# Altium schematic sheet Schematic_Project.SchDoc
size 1143 x 1143 mm; SheetNumber: 1; SheetTotal: 1
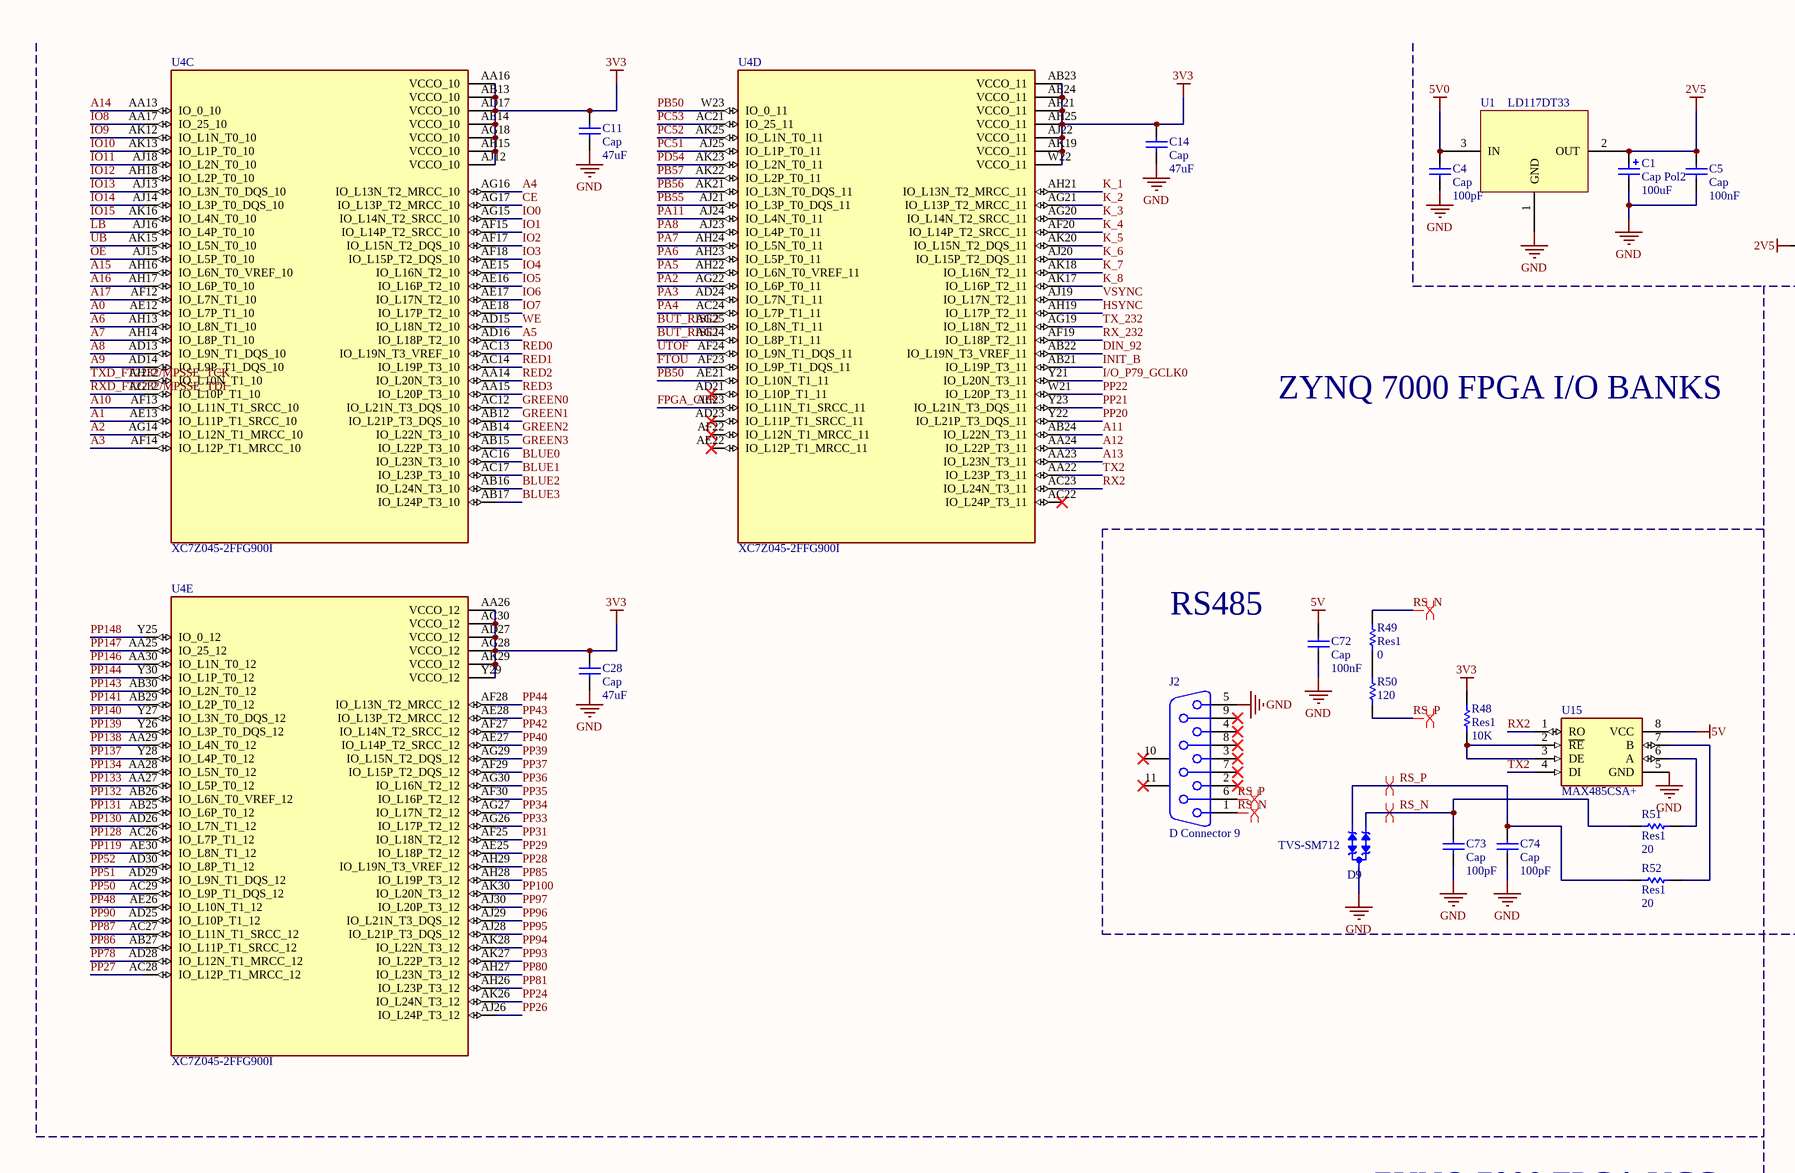
[diagram p0: Schematic_Project.SchDoc, top left]
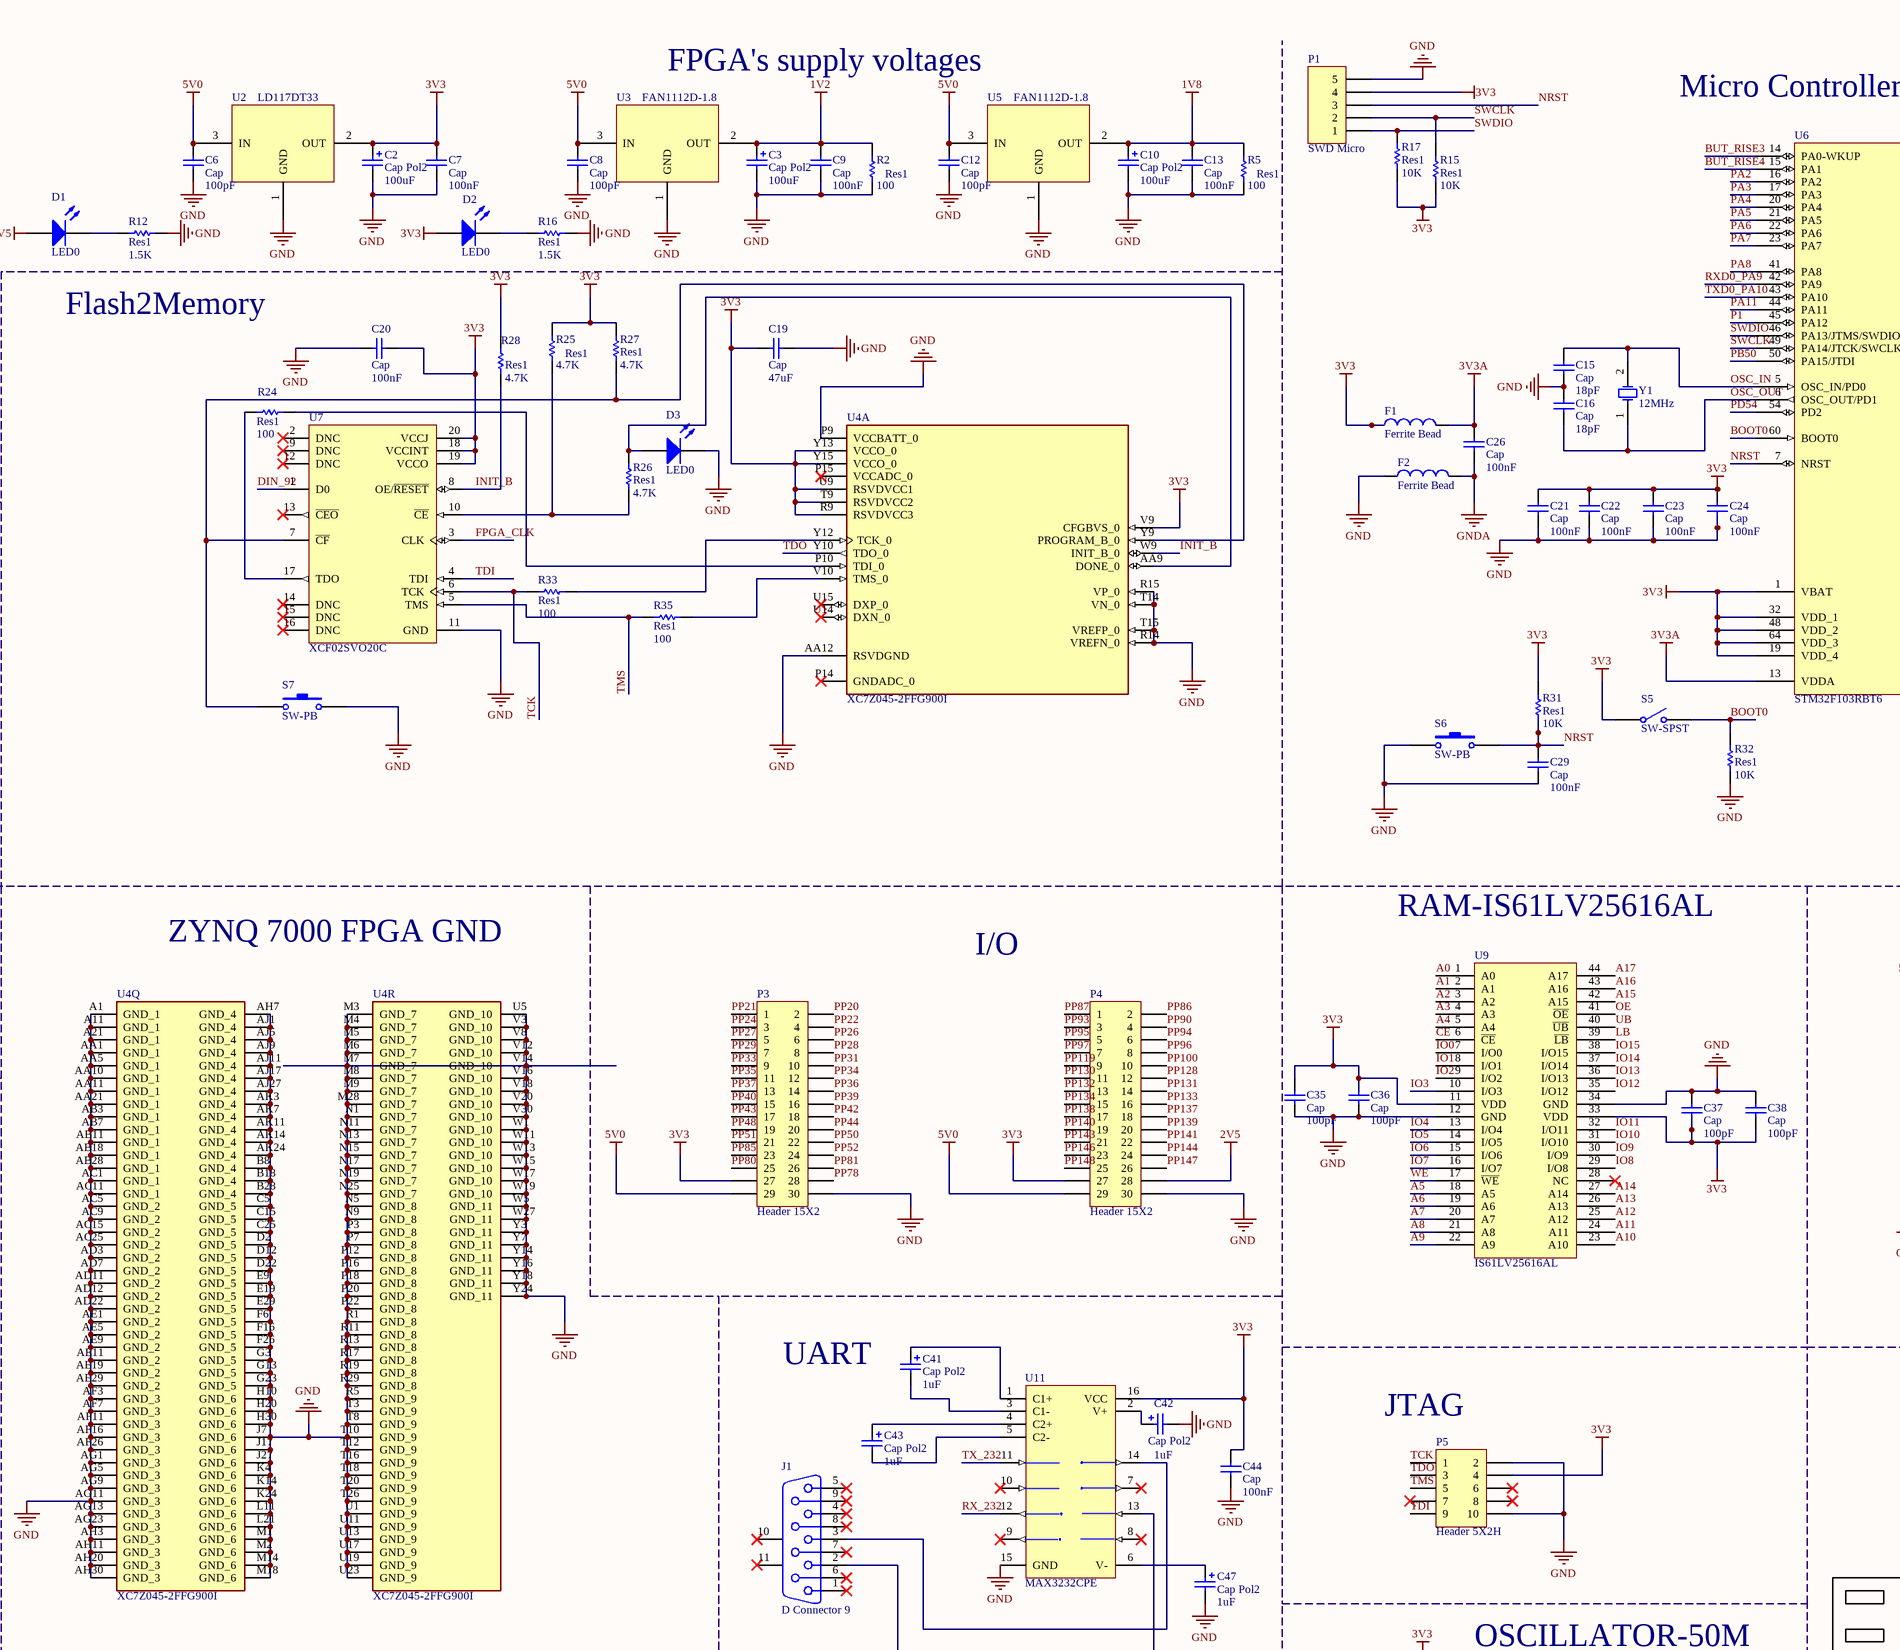
[diagram p1: Schematic_Project.SchDoc, top middle]
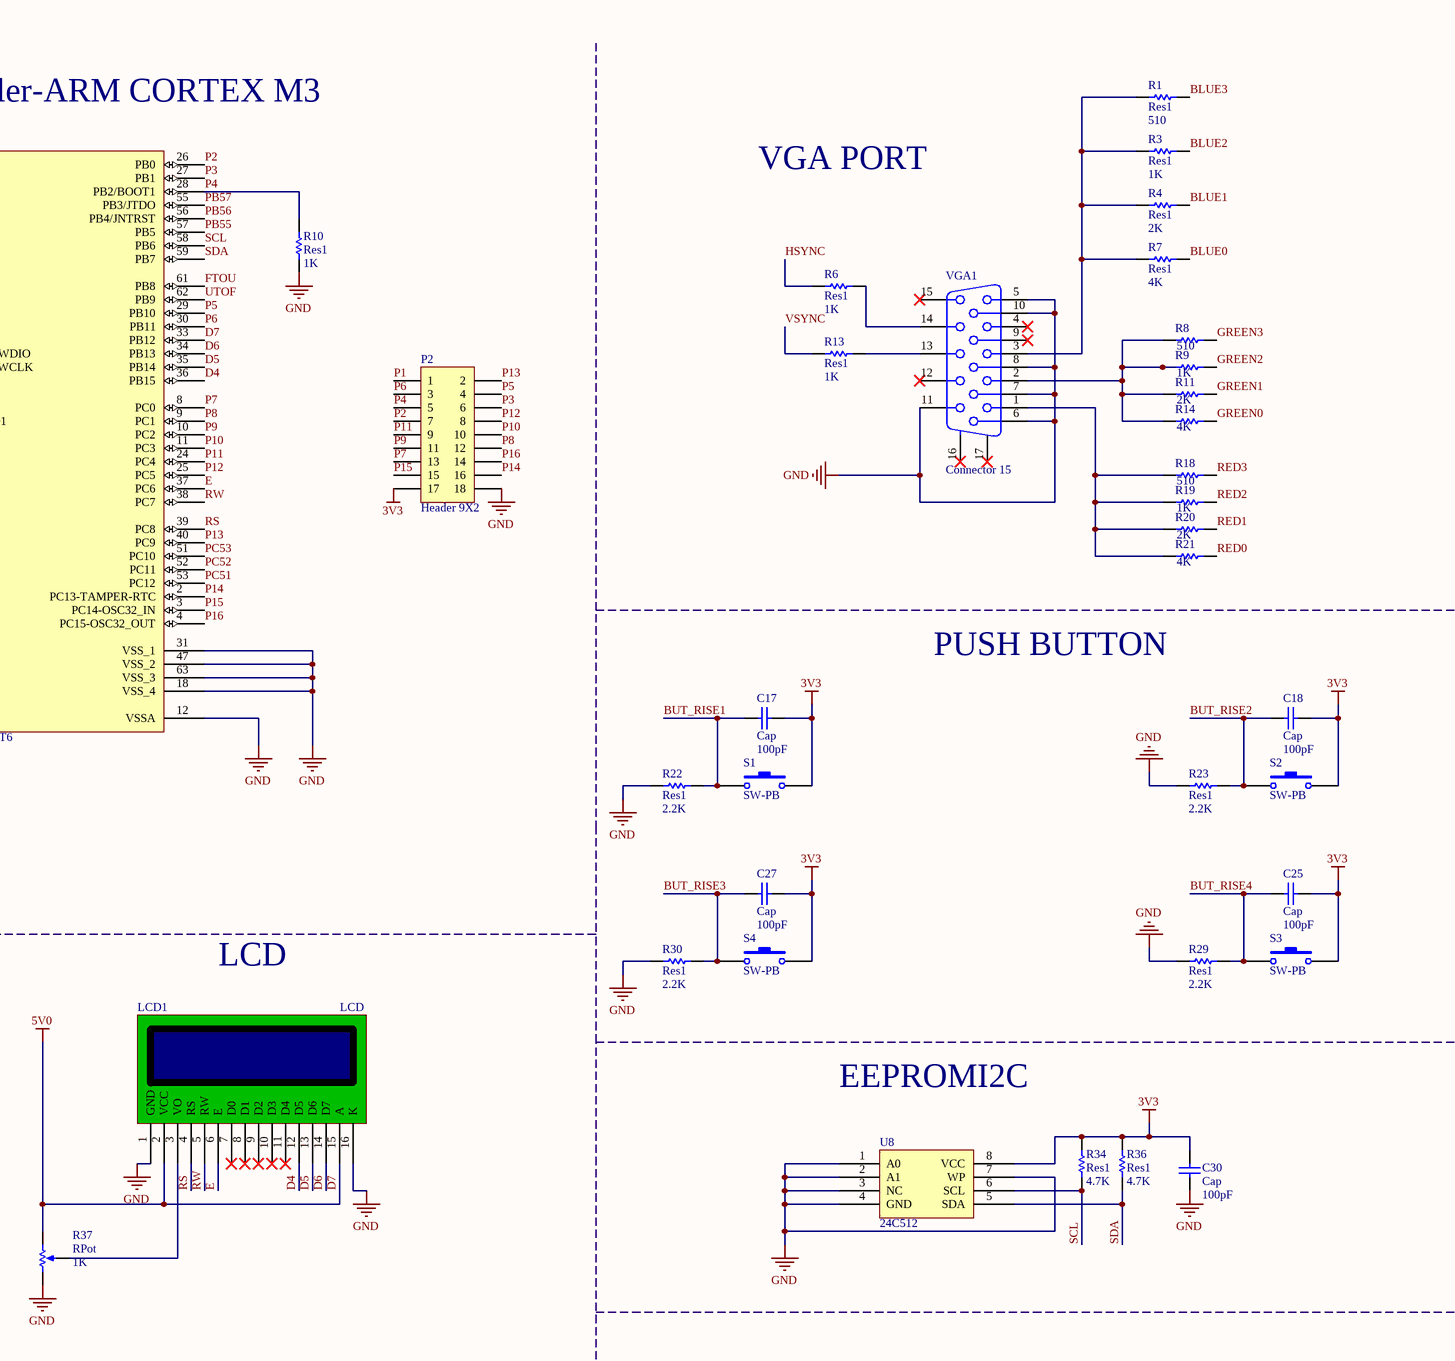
[diagram p2: Schematic_Project.SchDoc, top right]
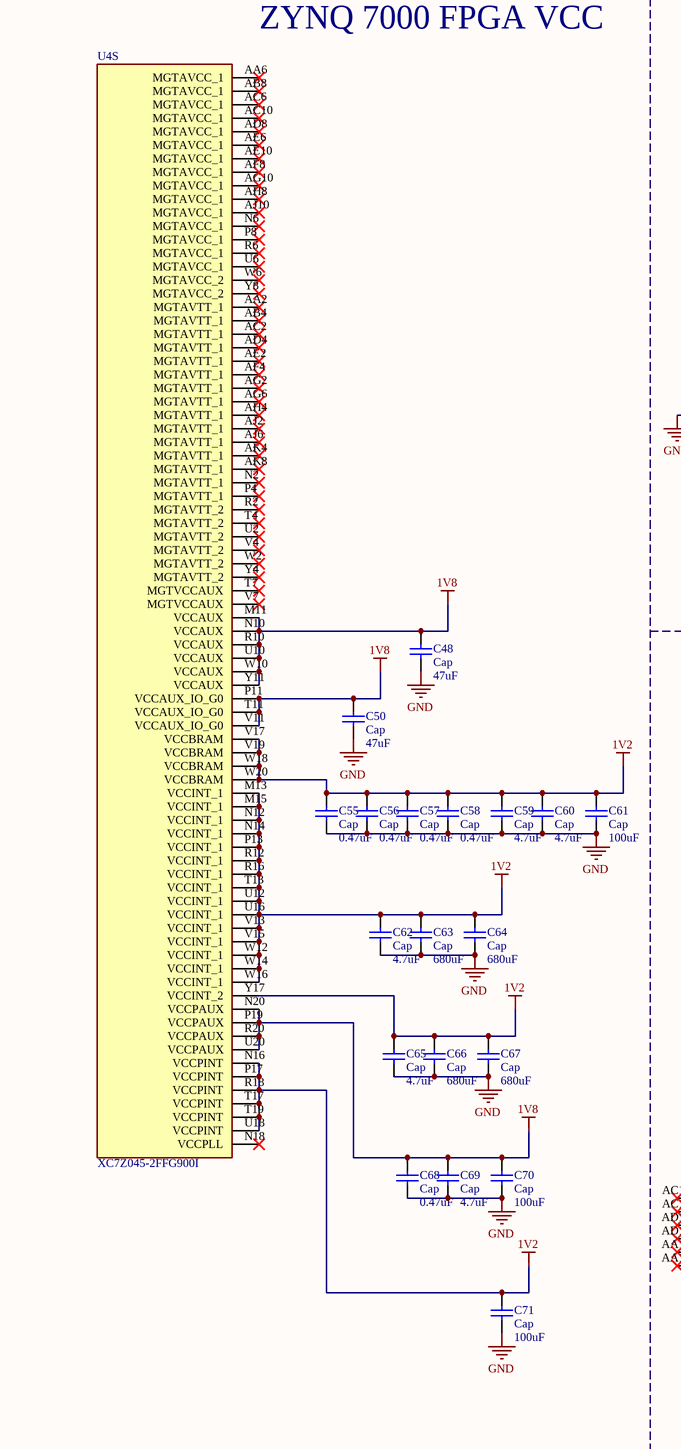
[diagram p3: Schematic_Project.SchDoc, bottom left]
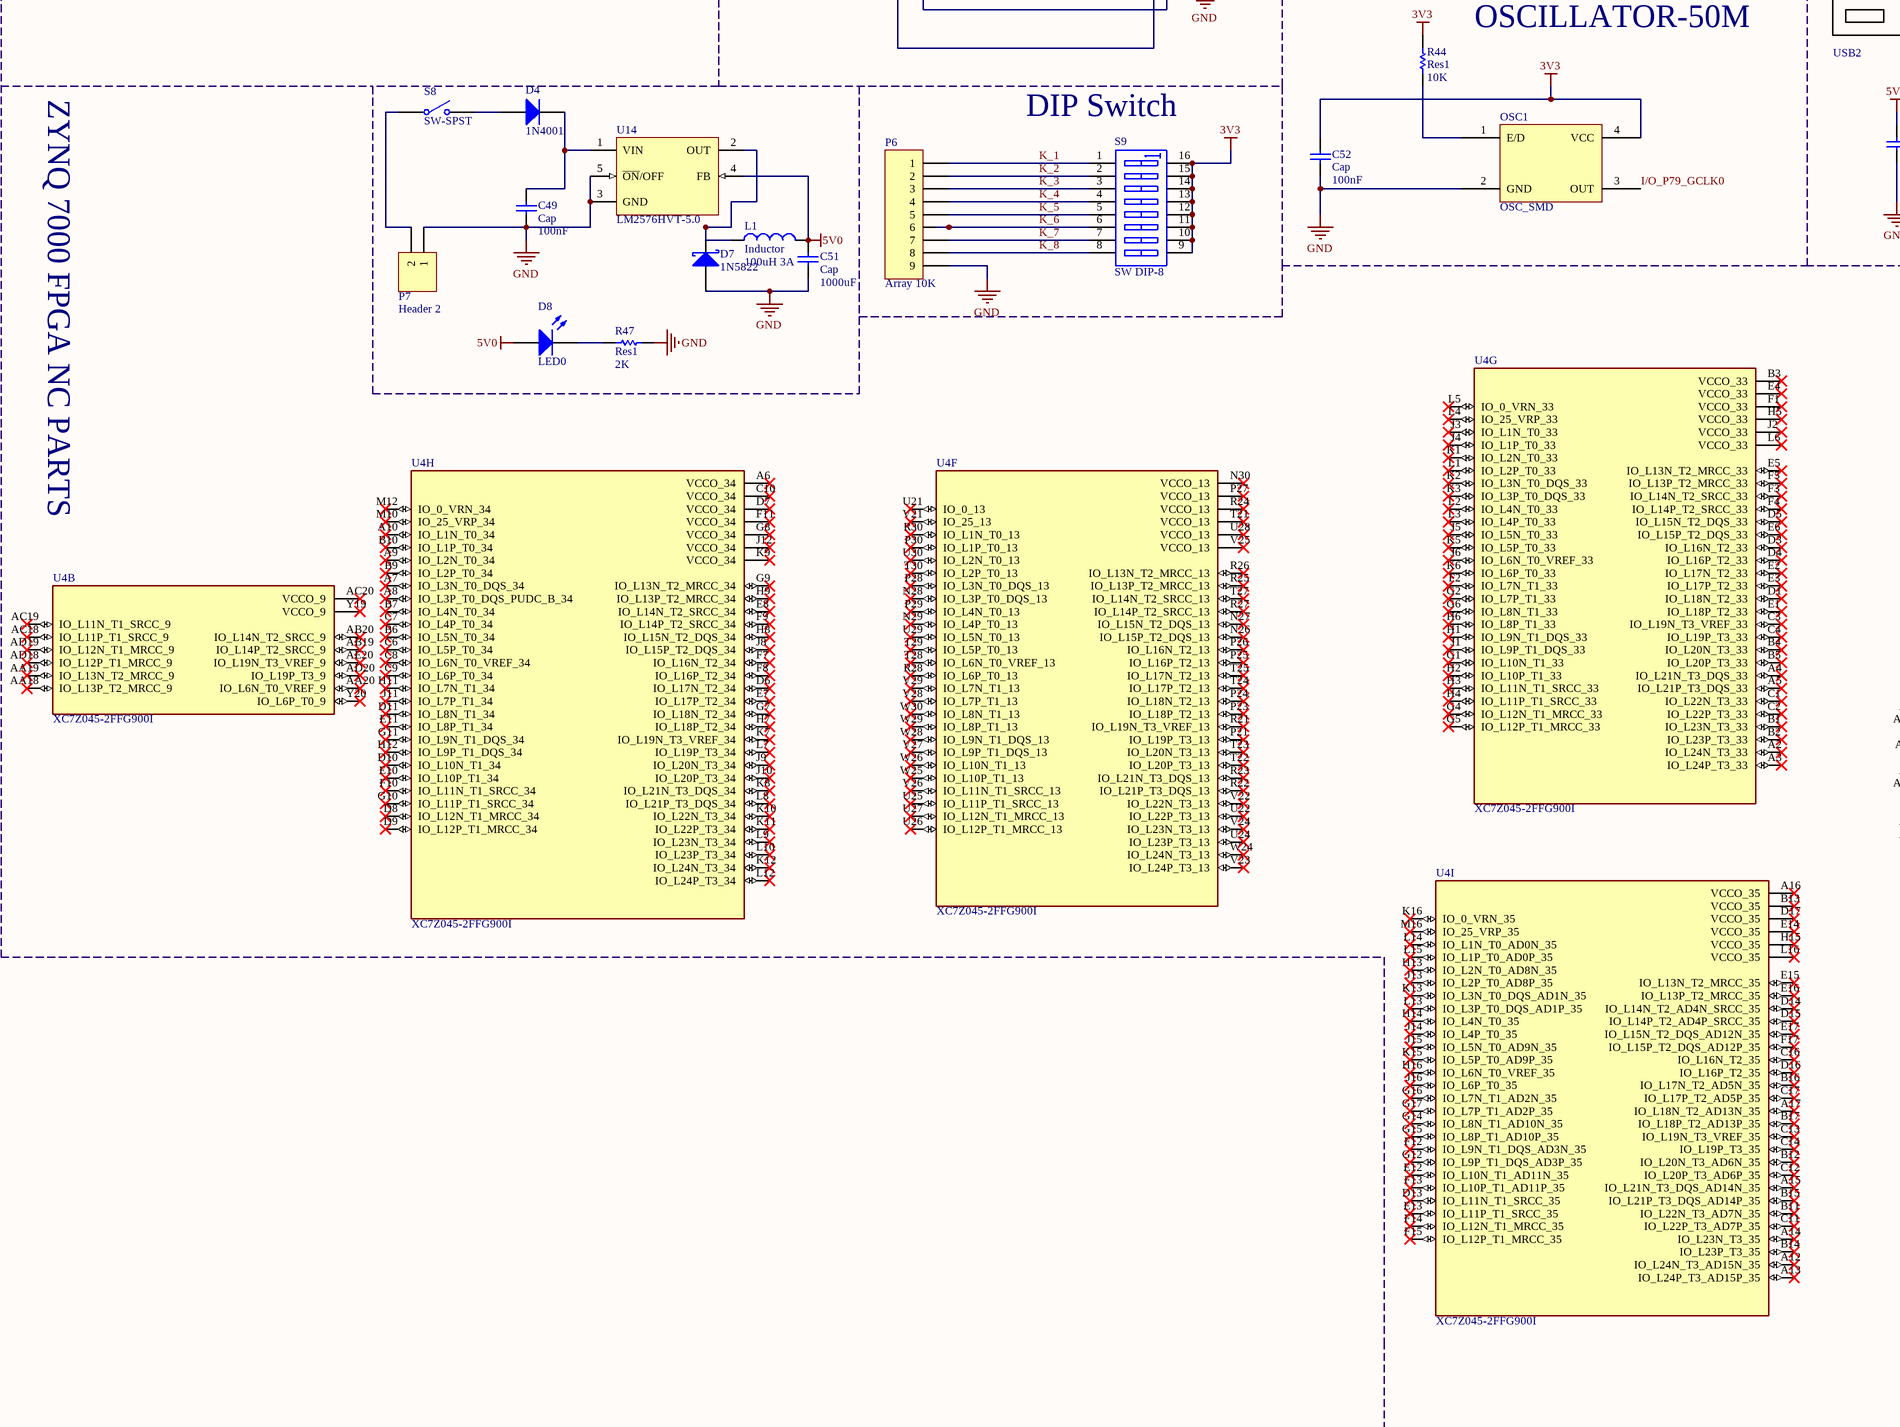
[diagram p4: Schematic_Project.SchDoc, bottom middle]
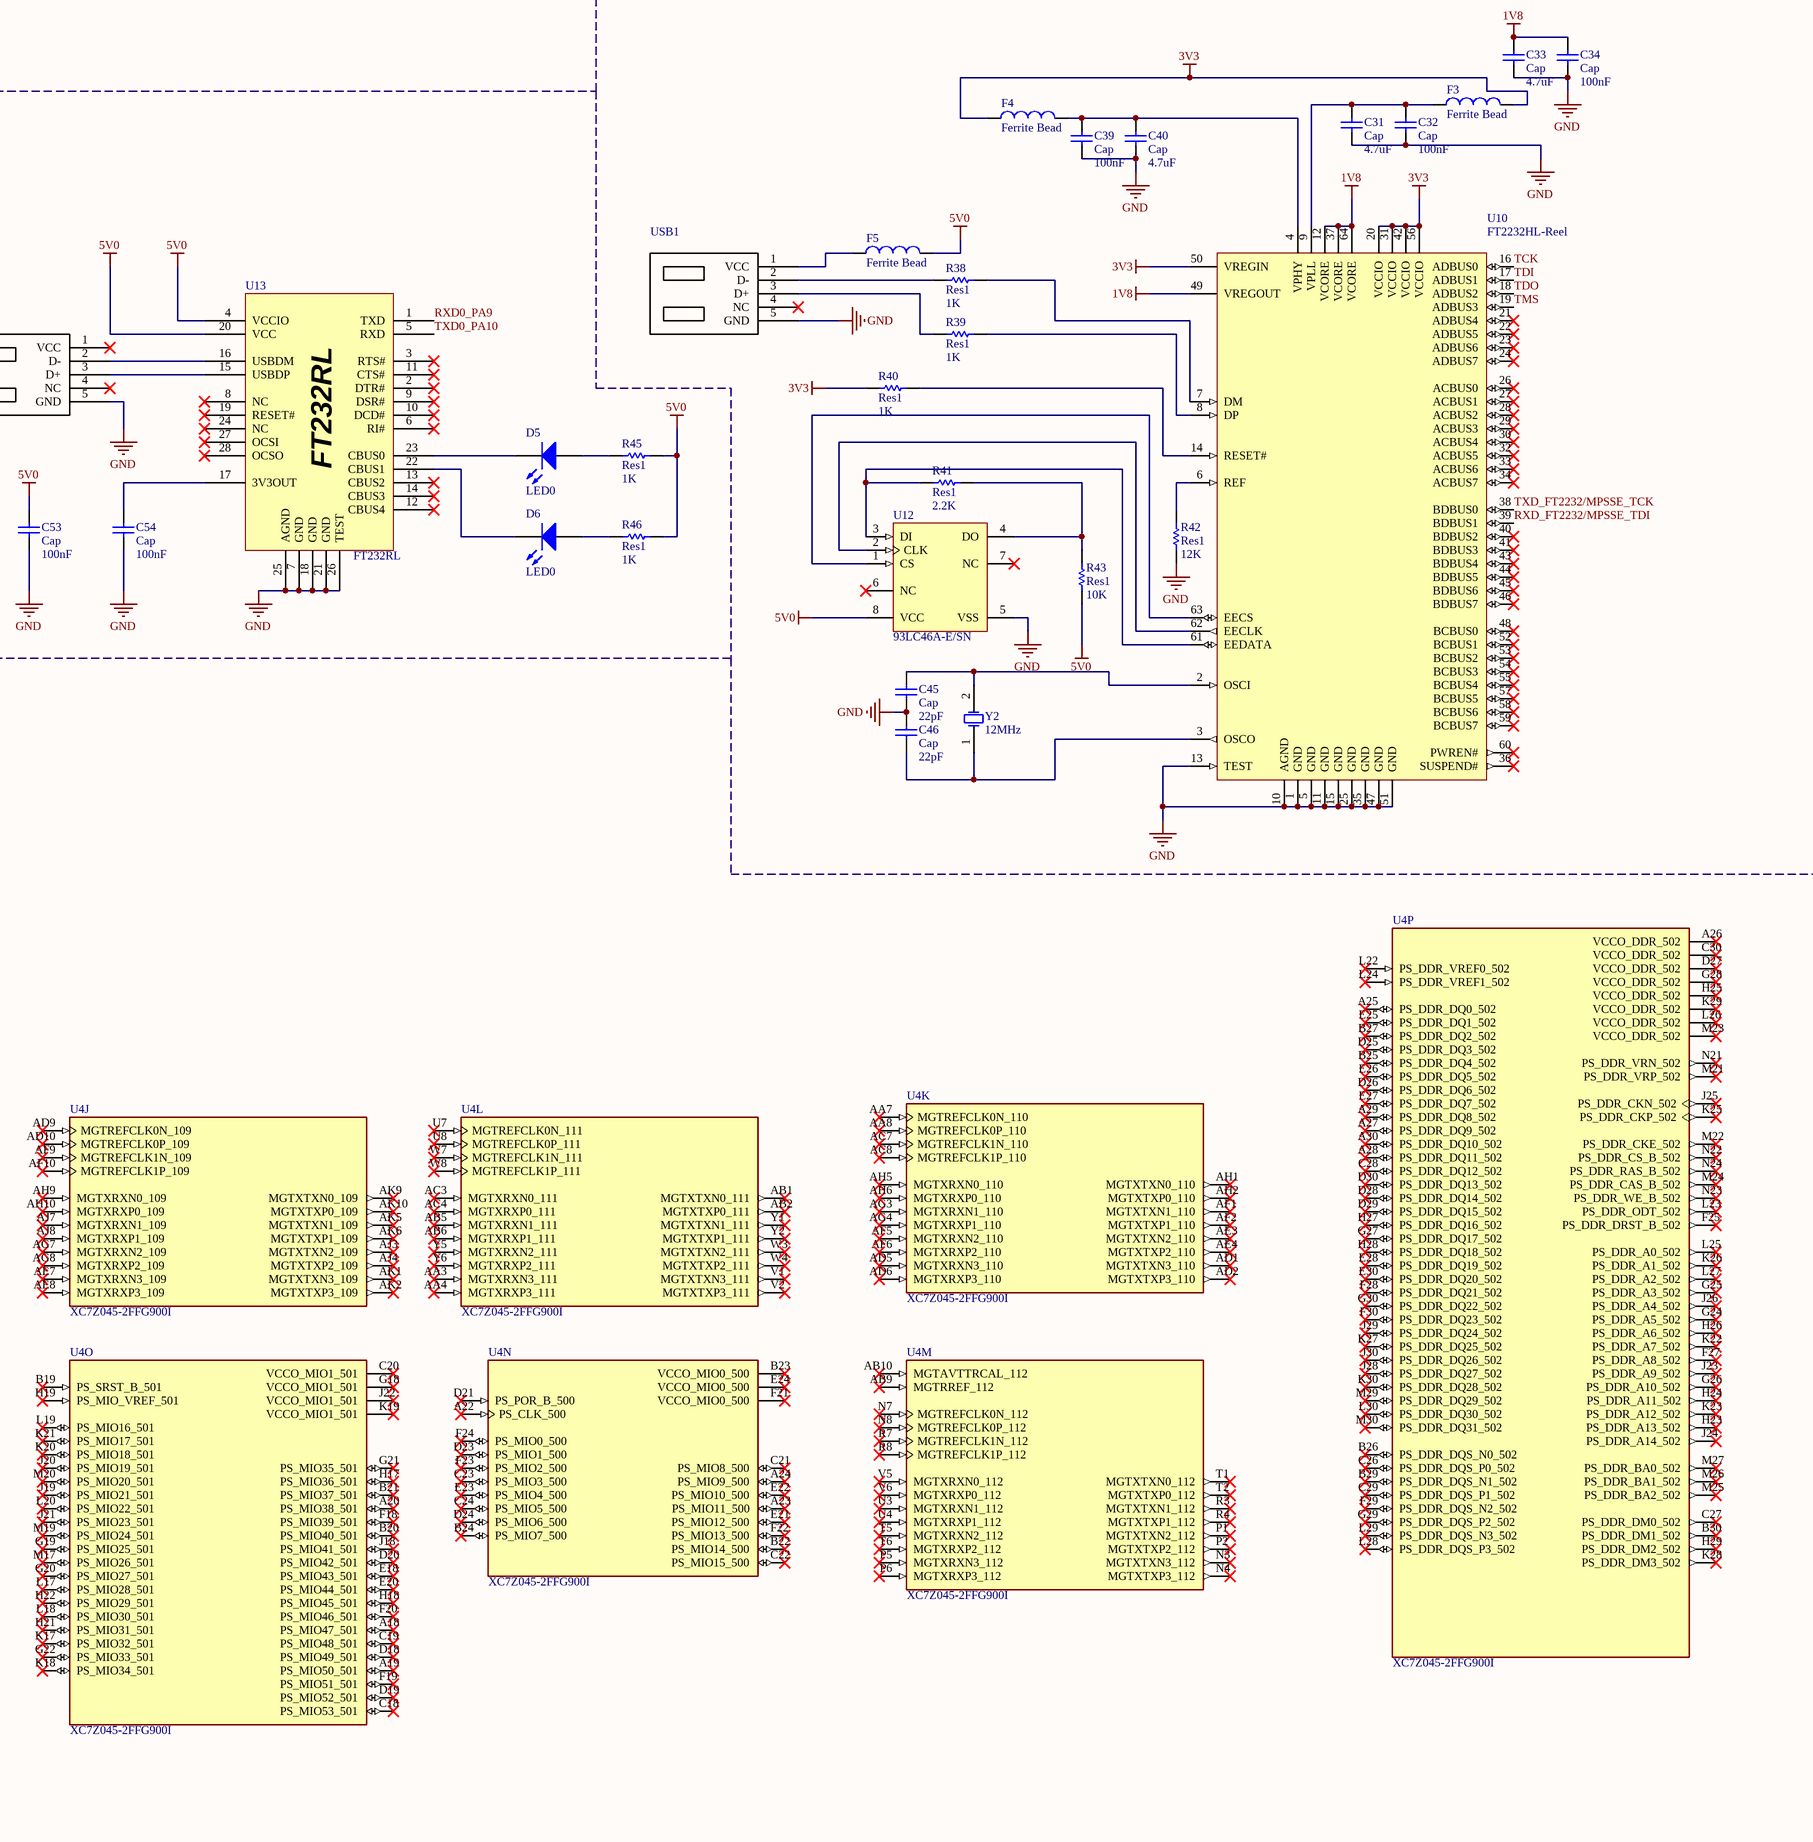
[diagram p5: Schematic_Project.SchDoc, bottom right]

## Parts
C1  Cap Pol2  value 100uF  [C_B]
C2  Cap Pol2  value 100uF  [C_B]
C3  Cap Pol2  value 100uF  [C_B]
C4  Cap  value 100pF  [SMD_805]
C5  Cap  value 100nF  [SMD_805]
C6  Cap  value 100pF  [SMD_805]
C7  Cap  value 100nF  [SMD_805]
C8  Cap  value 100pF  [SMD_805]
C9  Cap  value 100nF  [SMD_805]
C10  Cap Pol2  value 100uF  [C_B]
C11  Cap  value 47uF  [SMD_805]
C12  Cap  value 100pF  [SMD_805]
C13  Cap  value 100nF  [SMD_805]
C14  Cap  value 47uF  [SMD_805]
C15  Cap  value 18pF  [SMD_805]
C16  Cap  value 18pF  [SMD_805]
C17  Cap  value 100pF  [SMD_805]
C18  Cap  value 100pF  [SMD_805]
C19  Cap  value 47uF  [SMD_805]
C20  Cap  value 100nF  [SMD_805]
C21  Cap  value 100nF  [SMD_805]
C22  Cap  value 100nF  [SMD_805]
C23  Cap  value 100nF  [SMD_805]
C24  Cap  value 100nF  [SMD_805]
C25  Cap  value 100pF  [SMD_805]
C26  Cap  value 100nF  [SMD_805]
C27  Cap  value 100pF  [SMD_805]
C28  Cap  value 47uF  [SMD_805]
C29  Cap  value 100nF  [SMD_805]
C30  Cap  value 100pF  [SMD_805]
C31  Cap  value 4.7uF  [SMD_805]
C32  Cap  value 100nF  [SMD_805]
C33  Cap  value 4.7uF  [SMD_805]
C34  Cap  value 100nF  [SMD_805]
C35  Cap  value 100pF  [SMD_805]
C36  Cap  value 100pF  [SMD_805]
C37  Cap  value 100pF  [SMD_805]
C38  Cap  value 100pF  [SMD_805]
C39  Cap  value 100nF  [SMD_805]
C40  Cap  value 4.7uF  [SMD_805]
C41  Cap Pol2  value 1uF  [C_B]
C42  Cap Pol2  value 1uF  [C_B]
C43  Cap Pol2  value 1uF  [C_B]
C44  Cap  value 100nF  [SMD_805]
C45  Cap  value 22pF  [SMD_805]
C46  Cap  value 22pF  [SMD_805]
C47  Cap Pol2  value 1uF  [C_B]
C48  Cap  value 47uF  [SMD_805]
C49  Cap  value 100nF  [C_CYL_SMD]
C50  Cap  value 47uF  [SMD_805]
C51  Cap  value 1000uF  [C_CYL_SMD]
C52  Cap  value 100nF  [SMD_805]
C53  Cap  value 100nF  [SMD_805]
C54  Cap  value 100nF  [SMD_805]
C55  Cap  value 0.47uF  [SMD_805]
C56  Cap  value 0.47uF  [SMD_805]
C57  Cap  value 0.47uF  [SMD_805]
C58  Cap  value 0.47uF  [SMD_805]
C59  Cap  value 4.7uF  [SMD_805]
C60  Cap  value 4.7uF  [SMD_805]
C61  Cap  value 100uF  [SMD_805]
C62  Cap  value 4.7uF  [SMD_805]
C63  Cap  value 680uF  [SMD_805]
C64  Cap  value 680uF  [SMD_805]
C65  Cap  value 4.7uF  [SMD_805]
C66  Cap  value 680uF  [SMD_805]
C67  Cap  value 680uF  [SMD_805]
C68  Cap  value 0.47uF  [SMD_805]
C69  Cap  value 4.7uF  [SMD_805]
C70  Cap  value 100uF  [SMD_805]
C71  Cap  value 100uF  [SMD_805]
C72  Cap  value 100nF  [SMD_805]
C73  Cap  value 100pF  [SMD_805]
C74  Cap  value 100pF  [SMD_805]
D1  LED0  [SMD_805]
D2  LED0  [SMD_805]
D3  LED0  [SMD_805]
D4  1N4001  [TVS]
D5  LED0  [SMD_805]
D6  LED0  [SMD_805]
D7  1N5822  [1N5822]
D8  LED0  [SMD_805]
D9  TVS-SM712  [SOT-23_L]
F1  Ferrite Bead  [SMD_805]
F2  Ferrite Bead  [SMD_805]
F3  Ferrite Bead  [SMD_805]
F4  Ferrite Bead  [SMD_805]
F5  Ferrite Bead  [SMD_805]
J1  D Connector 9  [DSUB1.385-2H9]
J2  D Connector 9  [DSUB1.385-2H9]
L1  Inductor  value 100uH 3A  [INDUC_SMD]
LCD1  LCD  [LCD2x16_3d]
OSC1  OSC_SMD  [OSC_SMD]
P1  SWD Micro  [HDR1X5H]
P2  Header 9X2  [HEADER10x2]
P3  Header 15X2  [HDR2X15]
P4  Header 15X2  [HDR2X15]
P5  Header 5X2H  [HDR2X5H]
P6  Array 10K  [HDR1X9]
P7  Header 2  [HDR1X2]
R1  Res1  value 510  [SMD_805]
R2  Res1  value 100  [SMD_805]
R3  Res1  value 1K  [SMD_805]
R4  Res1  value 2K  [SMD_805]
R5  Res1  value 100  [SMD_805]
R6  Res1  value 1K  [SMD_805]
R7  Res1  value 4K  [SMD_805]
R8  value 510  [SMD_805]
R9  value 1K  [SMD_805]
R10  Res1  value 1K  [SMD_805]
R11  value 2K  [SMD_805]
R12  Res1  value 1.5K  [SMD_805]
R13  Res1  value 1K  [SMD_805]
R14  value 4K  [SMD_805]
R15  Res1  value 10K  [SMD_805]
R16  Res1  value 1.5K  [SMD_805]
R17  Res1  value 10K  [SMD_805]
R18  value 510  [SMD_805]
R19  value 1K  [SMD_805]
R20  value 2K  [SMD_805]
R21  value 4K  [SMD_805]
R22  Res1  value 2.2K  [SMD_805]
R23  Res1  value 2.2K  [SMD_805]
R24  Res1  value 100  [SMD_805]
R25  Res1  value 4.7K  [SMD_805]
R26  Res1  value 4.7K  [SMD_805]
R27  Res1  value 4.7K  [SMD_805]
R28  Res1  value 4.7K  [SMD_805]
R29  Res1  value 2.2K  [SMD_805]
R30  Res1  value 2.2K  [SMD_805]
R31  Res1  value 10K  [SMD_805]
R32  Res1  value 10K  [SMD_805]
R33  Res1  value 100  [SMD_805]
R34  Res1  value 4.7K  [SMD_805]
R35  Res1  value 100  [SMD_805]
R36  Res1  value 4.7K  [SMD_805]
R37  RPot  value 1K  [VR5]
R38  Res1  value 1K  [SMD_805]
R39  Res1  value 1K  [SMD_805]
R40  Res1  value 1K  [SMD_805]
R41  Res1  value 2.2K  [SMD_805]
R42  Res1  value 12K  [SMD_805]
R43  Res1  value 10K  [SMD_805]
R44  Res1  value 10K  [SMD_805]
R45  Res1  value 1K  [SMD_805]
R46  Res1  value 1K  [SMD_805]
R47  Res1  value 2K  [SMD_805]
R48  Res1  value 10K  [SMD_805]
R49  Res1  value 0  [SMD_805]
R50  120  [SMD_805]
R51  Res1  value 20  [SMD_805]
R52  Res1  value 20  [SMD_805]
S1  SW-PB  [RES_B]
S2  SW-PB  [RES_B]
S3  SW-PB  [RES_B]
S4  SW-PB  [RES_B]
S5  SW-SPST  [SPST-2]
S6  SW-PB  [RES_B]
S7  SW-PB  [RES_B]
S8  SW-SPST  [RES_B]
S9  SW DIP-8  [DIP_SW_8WAY_SMD]
U1  LD117DT33  [SOT223]
U2  LD117DT33  [SOT223]
U3  FAN1112D-1.8  [SOT223]
U4  XC7Z045-2FFG900I  [IC_XC7Z045-2FFG900I]  (parts A,B,C,D,E,F,G,H,I,J,K,L,M,N,O,P,Q,R,S of 19)
U5  FAN1112D-1.8  [SOT223]
U6  STM32F103RBT6  [LQFP64_L]
U7  XCF02SVO20C  [XCF02S]
U8  24C512  [SOP8]